# EasyEDA Pro project ProProject_Avaota Pi A_2024-03-25.epro, board PCB7
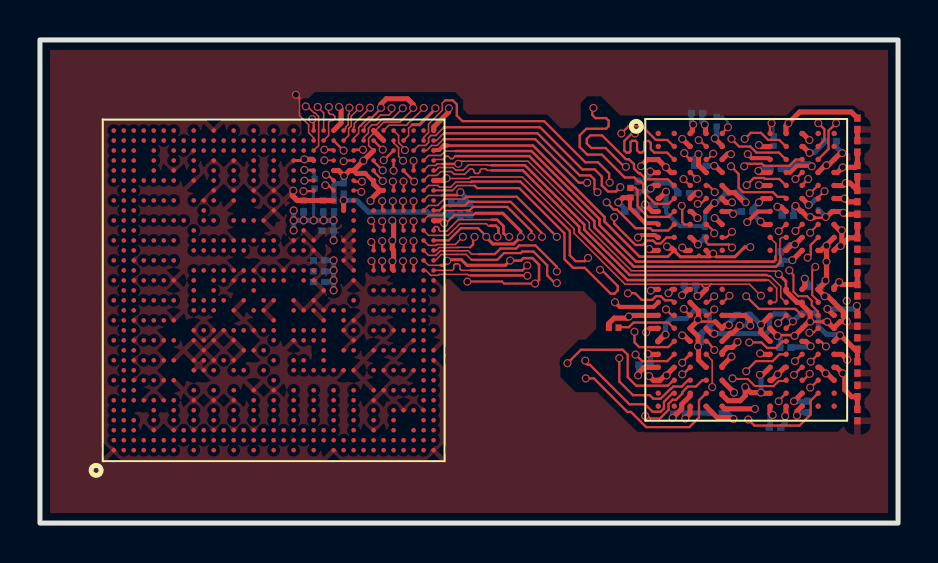
[diagram p17: board, top side]
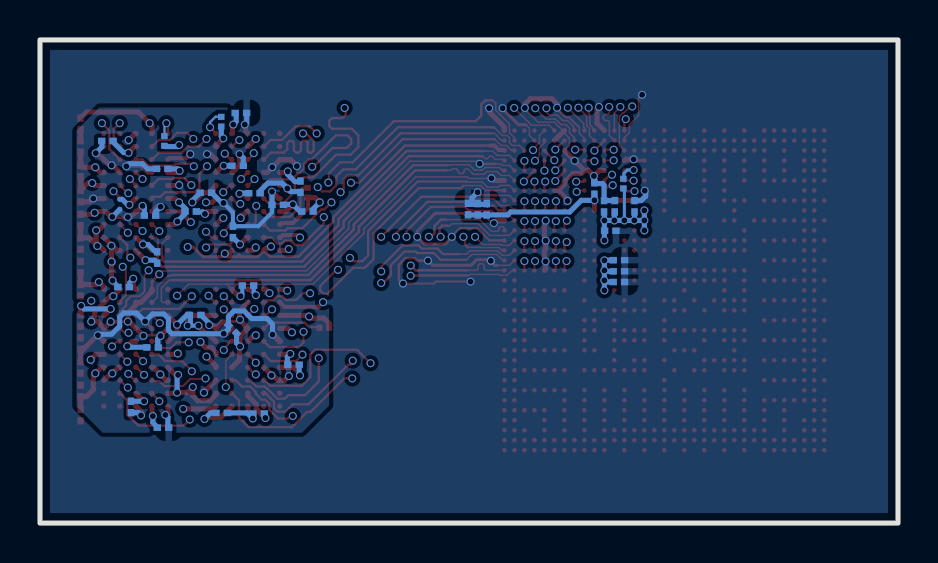
[diagram p18: board, bottom side, seen from below]

Outline 42.93 x 24.18 mm; copper layers: Top Layer, Inner1, Inner2, Inner3, Inner4, Inner5, Inner6, Bottom Layer. Coordinates in mm from the lower left corner of the outline.
Outline path: rectangle 0,24.18 42.93,0
Stack: Top Layer 0.035mm 外层铜厚1oz / Dielectric1 0.1164mm 2116 RC54% 4.9mil / Inner1 0.0152mm 内层铜厚 / Dielectric2 0.3mm 0.3mm H/HOZ 不含铜 / Inner2 0.0152mm 内层铜厚 / Dielectric3 0.0764mm 1080 RC67% 3.3mil / Inner3 0.0152mm 内层铜厚 / Dielectric4 0.0764mm 1080 RC67% 3.3mil / Inner4 0.0152mm 内层铜厚 / Dielectric5 0.3mm 0.3mm H/HOZ 不含铜 / Inner5 0.0152mm 内层铜厚 / Dielectric6 0.0764mm 1080 RC67% 3.3mil / Inner6 0.0152mm 内层铜厚 / Dielectric7 0.0764mm 1080 RC67% 3.3mil / Bottom Layer 0.035mm 外层铜厚1oz

## Design rules (mm)
net SDQM2: SDQ2
net SDQ22: SDQ2
net SDQ24: SDQ3
net SDQ21: SDQ2
net SDQ20: SDQ2
net SDQ31: SDQ3
net SDQ23: SDQ2
net SDQ19: SDQ2
net SDQ30: SDQ3
net SDQS2P: SDQ2
net SDQS2N: SDQ2
net SDQ26: SDQ3
net SDQ27: SDQ3
net SDQS3P: SDQ3
net SDQS3N: SDQ3
net SDQ17: SDQ2
net SDQM3: SDQ3
net SDQ18: SDQ2
net SDQ16: SDQ2
net SDQ28: SDQ3
net SDQ25: SDQ3
net SDQ29: SDQ3
net SAB2: SAA
net SAB3: SAA
net SAA5: SAA
net SAB0: SAA
net SCS0-B: SCK
net SCS1-B: SCK
net SCKE1-B: SCK
net SCKP-B: SCK
net SCKE0-B: SCK
net SAB1: SAA
net SAB5: SAA
net SCKN-B: SCK
net SAB4: SAA
net SCKE0-A: SCK
net SCS0-A: SCK
net SCKN-A: SCK
net SDQ14: SDQ1
net SAA4: SAA
net SDQ13: SDQ1
net SDQ12: SDQ1
net SDQ15: SDQ1
net SAA3: SAA
net SDQM1: SDQ1
net SDQS1P: SDQ1
net SDQS1N: SDQ1
net SDQ9: SDQ1
net SAA2: SAA
net SDQ10: SDQ1
net SDQ11: SDQ1
net SDQ8: SDQ1
net SCKP-A: SCK
net SCKE1-A: SCK
net SDQ1: SDQ0
net SDQ5: SDQ0
net SDQ7: SDQ0
net SDQ0: SDQ0
net SCS1-A: SCK
net SDQM0: SDQ0
net SDQS0P: SDQ0
net SDQS0N: SDQ0
net SDQ3: SDQ0
net SAA0: SAA
net SDQ4: SDQ0
net SDQ6: SDQ0
net SAA1: SAA
net SDQ2: SDQ0
template: 8L BGA
spacing safeClearance (default): track to track 0.076, other pairs 0.076 to 0.3
track width trackWidth (default): min 0.076, default 0.102, max 2.54
differential pair differentialPair (default): width min 0.102, default 0.254, max 2.54; gap min 0.102, default 0.102
via viaSize (default): diameter min 0.4, default 0.45, max 10; hole min 0.201, default 0.201, max 5.999
pour e746 uses DRAMCopper
pour e789 uses DRAMCopper
pour e875 uses DRAMCopper
pour e939 uses DRAMCopper
pour e1925 uses DRAMCopper

## Placement (name value [footprint] x y rotation side)
C1  2.2uF  [c0201 nsk]  33.83 5.51 180 bottom
C2  2.2uF  [c0201 nsk]  35.15 10.41 180 bottom
C3  100nF  [c0201 nsk]  36.78 4.78 0 bottom
C4  100nF  [c0201 nsk]  37.3 8.79 0 bottom
C5  100nF  [c0201 nsk]  39.55 19.13 180 bottom
C6  100nF  [c0201 nsk]  13.97 12.07 0 bottom
C7  100nF  [c0201 nsk]  13.97 12.6 0 bottom
C8  100nF  [c0201 nsk]  13.97 13.16 0 bottom
C9  100nF  [c0201 nsk]  14.71 15.85 270 bottom
C10  100nF  [c0201 nsk]  13.18 15.85 270 bottom
C11  100nF  [c0201 nsk]  14.17 15.85 270 bottom
C12  100nF  [c0201 nsk]  37.06 13.28 270 bottom
C13  100nF  [c0201 nsk]  36.8 17.73 180 bottom
C14  100nF  [c0201 nsk]  31.98 5.48 180 bottom
C15  100nF  [c0201 nsk]  32.51 11.89 180 bottom
C16  100nF  [c0201 nsk]  38.73 11.81 180 bottom
C17  2.2uF  [c0201 nsk]  15.19 16.75 90 bottom
C18  100nF  [c0201 nsk]  20.57 15.7 270 bottom
C19  2.2uF  [c0201 nsk]  40.89 8.99 90 top
C20  100nF  [c0201 nsk]  40.89 7.8 90 top
C21  100nF  [c0201 nsk]  37.41 15.39 180 bottom
C22  100nF  [c0201 nsk]  33.3 9.7 45 bottom
C23  100nF  [c0201 nsk]  31.04 15.93 0 bottom
C24  100nF  [c0201 nsk]  40.89 16.36 270 top
C25  100nF  [c0201 nsk]  33.27 14.58 90 bottom
C26  100nF  [c0201 nsk]  34.62 16.54 180 bottom
C27  2.2uF  [c0201 nsk]  30.25 7.92 0 bottom
C28  2.2uF  [c0201 nsk]  40.89 10.13 270 top
C29  100nF  [c0201 nsk]  35.39 15.6 0 bottom
C30  100nF  [c0201 nsk]  40.89 19.99 90 top
C31  100nF  [c0201 nsk]  40.89 18.85 270 top
C32  2.2uF  [c0201 nsk]  32.87 20.52 180 bottom
C33  100nF  [c0201 nsk]  40.89 17.63 90 top
C34  100nF  [c0201 nsk]  40.89 14 90 top
C35  100nF  [c0201 nsk]  40.89 11.66 90 top
C36  100nF  [c0201 nsk]  40.89 15.16 270 top
C37  100nF  [c0201 nsk]  40.89 12.8 270 top
C38  100nF  [c0201 nsk]  40.89 5.41 90 top
C39  100nF  [c0201 nsk]  40.89 6.6 270 top
C40  100nF  [c0201 nsk]  14.4 14.63 0 bottom
C41  100nF  [c0201 nsk]  33.05 17.88 0 bottom
C42  100nF  [c0201 nsk]  38.38 5.82 90 bottom
C43  100nF  [c0201 nsk]  32.21 16.51 0 bottom
C44  100nF  [c0201 nsk]  29.9 16.84 90 bottom
C45  100nF  [c0201 nsk]  29.54 15.6 180 bottom
C46  2.2uF  [c0201 nsk]  21.51 15.72 90 bottom
C47  100nF  [c0201 nsk]  21.03 15.7 270 bottom
R1  0  [r0201 nsk]  29.54 16.54 270 top
R2  0  [r0201 nsk]  28.7 9.78 180 top
R3  120  [r0201 nsk]  13.74 16.99 270 bottom
R4  240  [r0201 nsk]  33.86 20.09 270 bottom
R5  240  [r0201 nsk]  36.7 19.13 270 bottom
U1  T527  [T527-BGA664]  11.69 11.65 90 top
UD1  LPDDR4_FBGA200  [BGA200P65_80B1000_1500H90]  35.33 12.67 0 top

## Footprints (pads in the part's own frame, mm; a bottom-side part is the same pattern mirrored in y, then rotated)
BGA200P65_80B1000_1500H90
  round 0.27 smd: A1(-4.4,6.825) A2(-3.6,6.825) A3(-2.8,6.825) A4(-2,6.825) A5(-1.2,6.825) A8(1.2,6.825) A9(2,6.825) A10(2.8,6.825) A11(3.6,6.825) A12(4.4,6.825) AA1(-4.4,-6.175) AA2(-3.6,-6.175) AA3(-2.8,-6.175) AA4(-2,-6.175) AA5(-1.2,-6.175) AA8(1.2,-6.175) AA9(2,-6.175) AA10(2.8,-6.175) AA11(3.6,-6.175) AA12(4.4,-6.175) AB1(-4.4,-6.825) AB2(-3.6,-6.825) AB3(-2.8,-6.825) AB4(-2,-6.825) AB5(-1.2,-6.825) AB8(1.2,-6.825) AB9(2,-6.825) AB10(2.8,-6.825) AB11(3.6,-6.825) AB12(4.4,-6.825) B1(-4.4,6.175) B2(-3.6,6.175) B3(-2.8,6.175) B4(-2,6.175) B5(-1.2,6.175) B8(1.2,6.175) B9(2,6.175) B10(2.8,6.175) B11(3.6,6.175) B12(4.4,6.175) C1(-4.4,5.525) C2(-3.6,5.525) C3(-2.8,5.525) C4(-2,5.525) C5(-1.2,5.525) C8(1.2,5.525) C9(2,5.525) C10(2.8,5.525) C11(3.6,5.525) C12(4.4,5.525) D1(-4.4,4.875) D2(-3.6,4.875) D3(-2.8,4.875) D4(-2,4.875) D5(-1.2,4.875) D8(1.2,4.875) D9(2,4.875) D10(2.8,4.875) D11(3.6,4.875) D12(4.4,4.875) E1(-4.4,4.225) E2(-3.6,4.225) E3(-2.8,4.225) E4(-2,4.225) E5(-1.2,4.225) E8(1.2,4.225) E9(2,4.225) E10(2.8,4.225) E11(3.6,4.225) E12(4.4,4.225) F1(-4.4,3.575) F2(-3.6,3.575) F3(-2.8,3.575) F4(-2,3.575) F5(-1.2,3.575) F8(1.2,3.575) F9(2,3.575) F10(2.8,3.575) F11(3.6,3.575) F12(4.4,3.575) G1(-4.4,2.925) G2(-3.6,2.925) G3(-2.8,2.925) G4(-2,2.925) G5(-1.2,2.925) G8(1.2,2.925) G9(2,2.925) G10(2.8,2.925) G11(3.6,2.925) G12(4.4,2.925) H1(-4.4,2.275) H2(-3.6,2.275) H3(-2.8,2.275) H4(-2,2.275) H5(-1.2,2.275) H8(1.2,2.275) H9(2,2.275) H10(2.8,2.275) H11(3.6,2.275) H12(4.4,2.275) J1(-4.4,1.625) J2(-3.6,1.625) J3(-2.8,1.625) J4(-2,1.625) J5(-1.2,1.625) J8(1.2,1.625) J9(2,1.625) J10(2.8,1.625) J11(3.6,1.625) J12(4.4,1.625) K1(-4.4,0.975) K2(-3.6,0.975) K3(-2.8,0.975) K4(-2,0.975) K5(-1.2,0.975) K8(1.2,0.975) K9(2,0.975) K10(2.8,0.975) K11(3.6,0.975) K12(4.4,0.975) N1(-4.4,-0.975) N2(-3.6,-0.975) N3(-2.8,-0.975) N4(-2,-0.975) N5(-1.2,-0.975) N8(1.2,-0.975) N9(2,-0.975) N10(2.8,-0.975) N11(3.6,-0.975) N12(4.4,-0.975) P1(-4.4,-1.625) P2(-3.6,-1.625) P3(-2.8,-1.625) P4(-2,-1.625) P5(-1.2,-1.625) P8(1.2,-1.625) P9(2,-1.625) P10(2.8,-1.625) P11(3.6,-1.625) P12(4.4,-1.625) R1(-4.4,-2.275) R2(-3.6,-2.275) R3(-2.8,-2.275) R4(-2,-2.275) R5(-1.2,-2.275) R8(1.2,-2.275) R9(2,-2.275) R10(2.8,-2.275) R11(3.6,-2.275) R12(4.4,-2.275) T1(-4.4,-2.925) T2(-3.6,-2.925) T3(-2.8,-2.925) T4(-2,-2.925) T5(-1.2,-2.925) T8(1.2,-2.925) T9(2,-2.925) T10(2.8,-2.925) T11(3.6,-2.925) T12(4.4,-2.925) U1(-4.4,-3.575) U2(-3.6,-3.575) U3(-2.8,-3.575) U4(-2,-3.575) U5(-1.2,-3.575) U8(1.2,-3.575) U9(2,-3.575) U10(2.8,-3.575) U11(3.6,-3.575) U12(4.4,-3.575) V1(-4.4,-4.225) V2(-3.6,-4.225) V3(-2.8,-4.225) V4(-2,-4.225) V5(-1.2,-4.225) V8(1.2,-4.225) V9(2,-4.225) V10(2.8,-4.225) V11(3.6,-4.225) V12(4.4,-4.225) W1(-4.4,-4.875) W2(-3.6,-4.875) W3(-2.8,-4.875) W4(-2,-4.875) W5(-1.2,-4.875) W8(1.2,-4.875) W9(2,-4.875) W10(2.8,-4.875) W11(3.6,-4.875) W12(4.4,-4.875) Y1(-4.4,-5.525) Y2(-3.6,-5.525) Y3(-2.8,-5.525) Y4(-2,-5.525) Y5(-1.2,-5.525) Y8(1.2,-5.525) Y9(2,-5.525) Y10(2.8,-5.525) Y11(3.6,-5.525) Y12(4.4,-5.525)
c0201 nsk
  rect 0.368x0.324 smd: 1(-0.292,0) 2(0.28,0)
r0201 nsk
  rect 0.303x0.324 smd: 1(-0.241,0) 2(0.241,0)
T527-BGA664
  round 0.229 smd: A1(-8,8) A2(-7.5,8) A3(-7,8) A4(-6.5,8) A5(-6,8) A6(-5.5,8) A8(-4.5,8) A10(-3.5,8) A12(-2.5,8) A14(-1.5,8) A16(-0.5,8) A18(0.5,8) A20(1.5,8) A22(2.5,8) A24(3.5,8) A26(4.5,8) A28(5.5,8) A29(6,8) A30(6.5,8) A31(7,8) A32(7.5,8) A33(8,8) AA1(-8,-2) AA2(-7.5,-2) AA3(-7,-2) AA4(-6.5,-2) AA5(-6,-2) AA6(-5.5,-2) AA7(-5,-2) AA9(-4,-2) AA12(-2.5,-2) AA13(-2,-2) AA15(-1,-2) AA16(-0.5,-2) AA18(0.5,-2) AA19(1,-2) AA21(2,-2) AA22(2.5,-2) AA24(3.5,-2) AA26(4.5,-2) AA27(5,-2) AA28(5.5,-2) AA29(6,-2) AA30(6.5,-2) AA31(7,-2) AA32(7.5,-2) AA33(8,-2) AB2(-7.5,-2.501) AB3(-7,-2.5) AB9(-4,-2.501) AB10(-3.5,-2.5) AB11(-3,-2.5) AB12(-2.5,-2.5) AB13(-2,-2.5) AB14(-1.5,-2.5) AB15(-1,-2.5) AB17(0,-2.5) AB24(3.5,-2.5) AB32(7.5,-2.501) AB33(8,-2.5) AC1(-8,-3) AC2(-7.5,-3) AC3(-7,-3) AC4(-6.5,-3) AC5(-6,-3) AC6(-5.5,-3) AC7(-5,-3) AC9(-4,-3) AC15(-1,-3) AC17(0,-3) AC18(0.5,-3) AC19(1,-3) AC20(1.5,-3) AC22(2.5,-3) AC24(3.5,-3) AC26(4.5,-3) AC27(5,-3) AC28(5.5,-3) AC29(6,-3) AC30(6.5,-3) AC31(7,-3) AC32(7.5,-3) AC33(8,-3) AD1(-8,-3.5) AD2(-7.5,-3.5) AD9(-4,-3.5) AD11(-3,-3.5) AD13(-2,-3.5) AD14(-1.5,-3.5) AD15(-1,-3.5) AD20(1.5,-3.5) AD21(2,-3.5) AD22(2.5,-3.5) AD25(4,-3.5) AD32(7.5,-3.5) AD33(8,-3.5) AE1(-8,-4) AE2(-7.5,-4) AE3(-7,-4) AE4(-6.5,-4) AE5(-6,-4) AE6(-5.5,-4) AE7(-5,-4) AE9(-4,-4) AE11(-3,-4) AE12(-2.501,-4) AE13(-2,-4) AE14(-1.5,-4) AE16(-0.5,-4) AE18(0.5,-4) AE19(1,-4) AE20(1.5,-4) AE21(2,-4) AE22(2.501,-4) AE23(3,-4) AE24(3.5,-4) AE25(4,-4) AE26(4.5,-4) AE27(5,-4) AE28(5.5,-4) AE29(6,-4) AE30(6.5,-4) AE31(7,-4) AE32(7.5,-4) AE33(8,-4) AF1(-8,-4.5) AF2(-7.5,-4.5) AF32(7.5,-4.5) AF33(8,-4.5) AG1(-8,-5) AG2(-7.5,-5) AG3(-7,-5) AG4(-6.5,-5) AG5(-6,-5) AG6(-5.5,-5) AG7(-5,-5) AG9(-4,-5) AG11(-3,-5) AG13(-2,-5) AG15(-1,-5) AG17(0,-5) AG19(1,-5) AG21(2,-5) AG23(3,-5) AG25(4,-5) AG28(5.5,-5) AG29(6,-5) AG30(6.5,-5) AG31(7,-5) AG32(7.5,-5) AG33(8,-5) AH1(-8,-5.5) AH2(-7.5,-5.5) AH7(-5,-5.5) AH9(-4,-5.5) AH11(-3,-5.5) AH13(-2,-5.5) AH15(-1,-5.5) AH17(0,-5.5) AH19(1,-5.5) AH21(2,-5.5) AH23(3,-5.5) AH25(4,-5.5) AH27(5,-5.5) AH32(7.5,-5.5) AH33(8,-5.5) AJ1(-8,-6) AJ2(-7.5,-6) AJ3(-7,-6) AJ4(-6.5,-6) AJ5(-6,-6) AJ7(-5,-6) AJ9(-4,-6) AJ11(-3,-6) AJ13(-2,-6) AJ15(-1,-6) AJ17(0,-6) AJ19(1,-6) AJ21(2,-6) AJ23(3,-6) AJ25(4,-6) AJ27(5,-6) AJ30(6.5,-6) AJ31(7,-6) AJ32(7.5,-6) AJ33(8,-6) AK1(-8,-6.5) AK2(-7.5,-6.5) AK5(-6,-6.5) AK7(-5,-6.5) AK9(-4,-6.5) AK11(-3,-6.5) AK13(-2,-6.5) AK15(-1,-6.5) AK17(0,-6.5) AK19(1,-6.5) AK21(2,-6.5) AK23(3,-6.5) AK25(4,-6.5) AK27(5,-6.5) AK29(6,-6.5) AK32(7.5,-6.5) AK33(8,-6.5) AL1(-8,-7) AL2(-7.5,-7) AL3(-7,-7) AL5(-6,-7) AL7(-5,-7) AL9(-4,-7) AL11(-3,-7) AL12(-2.5,-7) AL13(-2,-7) AL14(-1.5,-7) AL15(-1,-7) AL16(-0.5,-7) AL17(0,-7) AL19(1,-7) AL21(2,-7) AL23(3,-7) AL25(4,-7) AL27(5,-7) AL29(6,-7) AL31(7,-7) AL32(7.5,-7) AL33(8,-7) AM1(-8,-7.5) AM2(-7.5,-7.5) AM3(-7,-7.5) AM4(-6.5,-7.5) AM5(-6,-7.5) AM6(-5.5,-7.5) AM7(-5,-7.5) AM8(-4.5,-7.5) AM9(-4,-7.5) AM10(-3.5,-7.5) AM11(-3,-7.5) AM12(-2.501,-7.5) AM13(-2,-7.5) AM14(-1.5,-7.5) AM15(-1,-7.5) AM16(-0.5,-7.5) AM17(0,-7.5) AM18(0.5,-7.5) AM19(1,-7.5) AM20(1.5,-7.5) AM21(2,-7.5) AM22(2.501,-7.5) AM23(3,-7.5) AM24(3.5,-7.5) AM25(4,-7.5) AM26(4.5,-7.5) AM27(5,-7.5) AM28(5.5,-7.5) AM29(6,-7.5) AM30(6.5,-7.5) AM31(7,-7.5) AM32(7.5,-7.5) AM33(8,-7.5) AN1(-8,-8) AN2(-7.5,-8) AN3(-7,-8) AN4(-6.5,-8) AN5(-6,-8) AN6(-5.5,-8) AN7(-5,-8) AN8(-4.5,-8) AN9(-4,-8) AN10(-3.5,-8) AN11(-3,-8) AN13(-2,-8) AN15(-1,-8) AN17(0,-8) AN18(0.5,-8) AN19(1,-8) AN20(1.5,-8) AN21(2,-8) AN22(2.5,-8) AN23(3,-8) AN24(3.5,-8) AN25(4,-8) AN26(4.5,-8) AN27(5,-8) AN28(5.5,-8) AN29(6,-8) AN30(6.5,-8) AN31(7,-8) AN32(7.5,-8) AN33(8,-8) B1(-8,7.5) B2(-7.5,7.5) B3(-7,7.5) B4(-6.5,7.5) B5(-6,7.5) B6(-5.5,7.5) B7(-5,7.5) B8(-4.5,7.5) B9(-4,7.5) B10(-3.5,7.5) B11(-3,7.5) B12(-2.501,7.5) B13(-2,7.5) B14(-1.5,7.5) B15(-1,7.5) B16(-0.5,7.5) B17(0,7.5) B18(0.5,7.5) B19(1,7.5) B20(1.5,7.5) B21(2,7.5) B22(2.501,7.5) B23(3,7.5) B24(3.5,7.5) B25(4,7.5) B26(4.5,7.5) B27(5,7.5) B28(5.5,7.5) B29(6,7.5) B30(6.5,7.5) B31(7,7.5) B32(7.5,7.5) B33(8,7.5) C1(-8,7) C2(-7.5,7) C3(-7,7) C4(-6.5,7) C6(-5.5,7) C7(-5,7) C8(-4.5,7) C9(-4,7) C10(-3.5,7) C11(-3,7) C12(-2.5,7) C13(-2,7) C14(-1.5,7) C15(-1,7) C16(-0.5,7) C17(0,7) C18(0.5,7) C19(1,7) C20(1.5,7) C21(2,7) C22(2.5,7) C23(3,7) C24(3.5,7) C25(4,7) C26(4.5,7) C27(5,7) C28(5.5,7) C29(6,7) C30(6.5,7) C31(7,7) C32(7.5,7) C33(8,7) D1(-8,6.5) D2(-7.5,6.5) D6(-5.5,6.5) D8(-4.5,6.5) D10(-3.5,6.5) D12(-2.5,6.5) D14(-1.5,6.5) D16(-0.5,6.5) D18(0.5,6.5) D20(1.5,6.5) D22(2.5,6.5) D24(3.5,6.5) D26(4.5,6.5) D28(5.5,6.5) D32(7.5,6.5) D33(8,6.5) E1(-8,6) E2(-7.5,6) E3(-7,6) E4(-6.5,6) E5(-6,6) E6(-5.5,6) E8(-4.5,6) E10(-3.5,6) E12(-2.5,6) E14(-1.5,6) E16(-0.5,6) E18(0.5,6) E20(1.5,6) E22(2.5,6) E24(3.5,6) E26(4.5,6) E28(5.5,6) E29(6,6) E30(6.5,6) E31(7,6) E32(7.5,6) E33(8,6) F1(-8,5.5) F2(-7.5,5.5) F6(-5.5,5.5) F8(-4.5,5.5) F10(-3.5,5.5) F12(-2.5,5.5) F14(-1.5,5.5) F16(-0.5,5.5) F18(0.5,5.5) F20(1.5,5.5) F22(2.5,5.5) F24(3.5,5.5) F26(4.5,5.5) F28(5.5,5.5) F32(7.5,5.5) F33(8,5.5) G1(-8,5) G2(-7.5,5) G3(-7,5) G4(-6.5,5) G5(-6,5) G6(-5.5,5) G8(-4.5,5) G10(-3.5,5) G12(-2.5,5) G14(-1.5,5) G16(-0.5,5) G18(0.5,5) G20(1.5,5) G22(2.5,5) G24(3.5,5) G26(4.5,5) G28(5.5,5) G29(6,5) G30(6.5,5) G31(7,5) G32(7.5,5) G33(8,5) H2(-7.5,4.5) H3(-7,4.5) H24(3.5,4.5) H31(7,4.5) H32(7.5,4.5) J1(-8,4) J2(-7.5,4) J3(-7,4) J4(-6.5,4) J5(-6,4) J6(-5.5,4) J7(-5,4) J9(-4,4) J10(-3.5,4) J12(-2.501,4) J13(-2,4) J15(-1,4) J16(-0.5,4) J17(0,4) J18(0.5,4) J19(1,4) J21(2,4) J22(2.501,4) J23(3,4) J26(4.5,4) J28(5.5,4) J29(6,4) J30(6.5,4) J31(7,4) J32(7.5,4) J33(8,4) K2(-7.5,3.5) K3(-7,3.5) K9(-4,3.5) K10(-3.5,3.5) K11(-3,3.5) K12(-2.5,3.5) K13(-2,3.5) K15(-1,3.5) K16(-0.5,3.5) K19(1,3.5) K21(2,3.5) K22(2.5,3.5) K24(3.5,3.5) K25(4,3.5) K26(4.5,3.5) K31(7,3.5) K32(7.5,3.5) L1(-8,3) L2(-7.5,3) L3(-7,3) L4(-6.5,3) L5(-6,3) L6(-5.5,3) L7(-5,3) L9(-4,3) L10(-3.5,3) L12(-2.5,3) L13(-2,3) L15(-1,3) L16(-0.5,3) L17(0,3) L18(0.5,3) L19(1,3) L21(2,3) L22(2.5,3) L24(3.5,3) L26(4.5,3) L27(5,3) L28(5.5,3) L29(6,3) L30(6.5,3) L31(7,3) L32(7.5,3) L33(8,3) M2(-7.5,2.501) M3(-7,2.5) M10(-3.5,2.5) M13(-2,2.5) M16(-0.5,2.5) M18(0.5,2.5) M19(1,2.5) M21(2,2.5) M22(2.5,2.5) M31(7,2.5) M32(7.5,2.501) N1(-8,2) N2(-7.5,2) N3(-7,2) N4(-6.5,2) N5(-6,2) N6(-5.5,2) N7(-5,2) N9(-4,2) N10(-3.5,2) N12(-2.5,2) N13(-2,2) N15(-1,2) N18(0.5,2) N19(1,2) N21(2,2) N22(2.5,2) N24(3.5,2) N26(4.5,2) N27(5,2) N28(5.5,2) N29(6,2) N30(6.5,2) N31(7,2) N32(7.5,2) N33(8,2) P2(-7.5,1.5) P3(-7,1.5) P9(-4,1.5) P11(-3,1.5) P13(-2,1.5) P16(-0.5,1.5) P18(0.5,1.5) P19(1,1.5) P21(2,1.5) P22(2.5,1.5) P24(3.5,1.5) P31(7,1.5) P32(7.5,1.5) R1(-8,1) R2(-7.5,1) R3(-7,1) R4(-6.5,1) R5(-6,1) R6(-5.5,1) R7(-5,1) R11(-3,1) R13(-2,1) R15(-1,1) R17(0,1) R18(0.5,1) R19(1,1) R22(2.5,1) R24(3.5,1) R26(4.5,1) R27(5,1) R28(5.5,1) R29(6,1) R30(6.5,1) R31(7,1) R32(7.5,1) R33(8,1) T2(-7.5,0.5) T3(-7,0.5) T9(-4,0.5) T11(-3,0.5) T13(-2,0.5) T15(-1,0.5) T16(-0.5,0.5) T18(0.5,0.5) T19(1,0.5) T21(2,0.5) T22(2.5,0.5) T24(3.5,0.5) T31(7,0.5) T32(7.5,0.5) U1(-8,0) U2(-7.5,0) U3(-7,0) U4(-6.5,0) U5(-6,0) U6(-5.5,0) U7(-5,0) U8(-4.5,0) U10(-3.5,0) U12(-2.5,0) U13(-2,0) U14(-1.5,0) U16(-0.5,0) U18(0.5,0) U19(1,0) U21(2,0) U22(2.5,0) U25(4,0) U26(4.5,0) U27(5,0) U28(5.5,0) U29(6,0) U30(6.5,0) U31(7,0) U32(7.5,0) U33(8,0) V2(-7.5,-0.5) V3(-7,-0.5) V18(0.5,-0.5) V19(1,-0.5) V31(7,-0.5) V32(7.5,-0.5) W1(-8,-1) W2(-7.5,-1) W3(-7,-1) W4(-6.5,-1) W5(-6,-1) W6(-5.5,-1) W7(-5,-1) W9(-4,-1) W10(-3.5,-1) W12(-2.5,-1) W13(-2,-1) W15(-1,-1) W16(-0.5,-1) W19(1,-1) W21(2,-1) W22(2.5,-1) W23(3,-1) W24(3.5,-1) W25(4,-1) W27(5,-1) W28(5.5,-1) W29(6,-1) W30(6.5,-1) W31(7,-1) W32(7.5,-1) W33(8,-1) Y2(-7.5,-1.5) Y3(-7,-1.5) Y9(-4,-1.5) Y10(-3.5,-1.5) Y12(-2.5,-1.5) Y13(-2,-1.5) Y15(-1,-1.5) Y18(0.5,-1.5) Y19(1,-1.5) Y21(2,-1.5) Y22(2.5,-1.5) Y23(3,-1.5) Y24(3.5,-1.5) Y26(4.5,-1.5) Y31(7,-1.5) Y32(7.5,-1.5)

## Nets
As in the schematic.

Pads without a net: U1 A2 A3 A4 A5 A6 A8 A10 A12 A14 A16 A18 A20 A22 A24 A26 A28 A29 A30 A31 A32 A33 AA1 AA2 AA3 AA4 AA5 AA6 AA7 AA9 AA12 AA13 AA19 AB2 AB3 AB9 AB13 AC2 AC3 AC4 AC5 AC6 AC7 AC9 AC15 AD1 AD2 AD15 AE1 AE2 AE3 AE4 AE5 AE6 AE7 AE11 AE13 AE16 AF1 AF2 AG1 AG2 AG4 AG5 AG9 AG13 AG15 AG17 AH1 AH2 AH11 AH13 AH15 AH17 AJ1 AJ2 AJ3 AJ4 AJ5 AJ7 AJ9 AJ11 AJ15 AJ17 AK1 AK2 AK7 AK9 AK13 AK15 AK17 AK33 AL1 AL2 AL5 AL7 AL11 AL15 AL16 AL17 AL27 AL32 AL33 AM1 AM2 AM3 AM4 AM6 AM7 AM8 AM9 AM10 AM11 AM12 AM13 AM14 AM15 AM16 AM17 AM18 AM33 AN2 AN3 AN4 AN5 AN6 AN7 AN8 AN9 AN13 AN15 AN17 AN26 B1 B2 B3 B4 B5 B6 B7 B8 B9 B10 B11 B12 B13 B14 B15 B16 B17 B18 B19 B20 B21 B22 B23 B24 B25 B26 B27 B28 B29 B30 B31 B32 B33 C1 C2 C3 C4 C7 C9 C11 C13 C15 C16 C17 C19 C21 C22 C23 C24 C25 C26 C27 C28 C29 C30 C31 C32 C33 D1 D2 D8 D10 D12 D14 D16 D18 D20 D22 D24 D26 D28 D32 D33 E1 E2 E4 E5 E6 E8 E10 E12 E14 E16 E18 E20 E22 E24 E26 E28 E29 E30 E31 E32 E33 F1 F2 F14 F16 F18 F20 F22 F24 F26 F28 F32 F33 G1 G2 G4 G5 G6 G12 G16 G20 G22 G24 G26 G28 G30 G31 G32 G33 H2 H3 H24 H31 H32 J1 J2 J4 J5 J7 J15 J16 J17 J18 J19 J21 J22 J23 J26 J29 J30 J32 J33 K2 K3 K13 K15 K16 K19 K21 K22 K24 K25 K31 K32 L1 L2 L4 L5 L7 L9 L15 L16 L17 L18 L19 L21 L22 L24 L26 L28 L29 L31 L32 M2 M3 M10 M16 M18 M19 M21 M22 M31 M32 N1 N2 N4 N5 N7 N9 N13 N21 N24 N28 N29 N31 N32 N33 P2 P3 P9 P13 P18 P21 P22 P31 P32 R1 R2 R4 R5 R6 R15 R17 R18 R22 R26 R28 R29 R30 R31 R32 R33 T2 T3 T9 T11 T13 T19 T21 T22 T31 T32 U1 U2 U3 U4 U5 U6 U8 U10 U12 U13 U18 U19 U21 U22 U26 U28 U29 U30 U31 U32 U33 V2 V3 V31 V32 W1 W2 W3 W4 W5 W6 W7 W9 W10 W19 W21 W28 W29 W31 W32 W33 Y2 Y3 Y9 Y10 Y12 Y13 Y19 Y21 Y31 Y32; UD1 A1 A2 A11 A12 AA1 AA12 AB1 AB2 AB11 AB12 B1 B12 G11 K5 K8 N5 N8

## Via types
v1: diameter 0.4, hole 0.3, Top Layer to Bottom Layer, 282 vias

## Routing (per net, layer and track width the routed paths; a pad name or vN(x,y) marks a point on that pad's centre or on a via; arc(x,y) is an arc through that point)
GND: length 193.2
  Top Layer w0.076: 16.03,19.89 15.94,19.8 15.94,19.51 15.69,19.26 U1.AE32 ; 18.62,19.94 18.44,19.76 18.44,19.4 U1.AK32 ; 33.06,11.96 33.58,11.96 ; 33.06,11.96 29.27,11.96 28,13.22 28,13.22 26.72,14.5 26.72,14.73 24.13,17.32 21.54,17.32 21.46,17.25 20.4,17.25 20.38,17.26 v1(20.34,17.26) ; 33.06,11.96 33.32,11.69 33.58,11.96 ; 33.58,11.96 35.49,11.96 v1(36.07,11.38) ; U1.AM20 19.44,12.9 20.05,12.9 ; 16.69,19.51 16.44,19.26 16.44,18.9 U1.AG31 ; 12.98,21.27 12.98,20.4 13.44,19.93 13.44,19.54 13.69,19.29 U1.AA32 ; U1.AG33 16.77,19.65 16.94,19.81 16.94,19.81 17.2,20.07 18.01,20.07 18.67,20.73 v1(18.67,20.78) ; U1.AM29 19.44,17.9 19.79,17.9 19.79,17.9 19.87,17.98 20.15,17.98 ; U1.AM26 19.44,16.4 20.11,16.4 ; v1(20.93,17.98) 21.06,18.11 24.41,18.11 27.48,15.04 27.48,14.73 29.59,12.63 36.48,12.63 36.49,12.62 36.8,12.62 v1(36.96,12.46) ; v1(12.8,21.43) 12.79,21.43 12.78,21.42 12.88,21.32
  Top Layer w0.102: v1(17.06,20.79) 17.06,20.74 16.62,20.31 16.46,20.31 16.04,19.89 16.03,19.89 ; v1(21.39,12.08) 21.39,12.09 23.11,12.09 23.22,11.99 v1(24.77,11.99) ; 16.69,19.51 U1.AG33 ; 21.8,15.5 21.76,15.5 21.67,15.42 20.72,15.42 20.32,15.01 v1(20.22,15.01)
  Top Layer w0.115: U1.AN22 20.45,14.15 21.06,14.76 21.92,14.76 22.33,14.35 v1(22.33,14.33)
  Top Layer w0.127: v1(12.8,21.43) 12.8,21.38 12.87,21.38 12.98,21.27 ; 20.11,16.4 20.13,16.42 20.89,16.42 v1(21.03,16.56) ; 38.71,15.28 39.31,15.28 ; 33.78,10.08 33.02,10.08 v1(32.92,10.18) ; 20.15,17.98 20.86,17.98 20.86,17.98 v1(20.93,17.98) ; v1(23.52,13.14) 24.06,13.14 24.18,13.26 24.64,13.26 24.97,12.93 24.97,12.17 24.79,11.99 v1(24.77,11.99) ; 20.39,18.9 24.66,18.9 28.24,15.32 28.24,15.09 30,13.34 31.41,13.34 31.72,13.64 ; v1(38.53,10.08) 38.54,10.08 39.2,10.08 ; v1(36.9,9.36) 36.94,9.41 37.71,9.41 v1(37.75,9.37) ; 37.32,11.69 37.32,12.09
  Top Layer w0.152: 18.62,19.94 18.99,19.94 19.77,20.73 19.77,20.76 v1(19.78,20.76) ; v1(35.53,13.82) 35.26,13.82 34.76,13.33 33.84,13.33 v1(33.68,13.49) 33.52,13.33 33.05,13.33 32.97,13.41 32.88,13.33 32.04,13.33 31.72,13.64 ; U1.W30 13.17,18.15 v1(13.23,18.2) ; v1(23.52,13.14) 23.29,12.9 21.36,12.9 21.08,13.18 20.43,13.18 v1(20.37,13.13) 20.37,13.1 20.17,12.9 20.05,12.9 ; v1(22.33,14.33) 22.33,14.3 22.66,13.97 23.7,13.97 v1(24.05,14.33) 24.05,14.61 23.15,15.5 21.8,15.5 ; v1(36.96,12.46) 37.32,12.09
  Top Layer w0.203: 37.32,17.54 37.53,17.54 37.87,17.88 38.58,17.88 v1(38.61,17.86) ; 30.92,11.04 30.7,10.82 29,10.82 v1(28.76,11.06) ; 16.28,17.5 16.63,17.15 U1.AG28 ; v1(35.38,15.06) 35.91,15.59 36.52,15.59 ; 36.52,18.19 36.45,18.26 35.61,18.26 v1(35.41,18.47) ; 30.92,14.29 30.89,14.29 30.77,14.41 30.09,14.41 29.97,14.3 29.93,14.3 v1(29.92,14.29) ; U1.AN31 19.72,18.67 19.97,18.67 20.19,18.9 20.39,18.9
  Top Layer w0.254: 34.12,5.84 34.25,5.72 v1(35.76,5.72) ; 39.31,15.28 39.36,15.32 ; 39.36,15.32 39.63,15.59 40.13,15.59 v1(40.19,15.53) 40.27,15.46 C36.1 ; 39.36,15.32 v1(39.31,15.32) ; v1(40.39,8.17) 40.12,8.44 39.72,8.44 ; v1(20.22,15.01) 20.1,15.13 19.71,15.13 U1.AN24 ; v1(35.97,16.92) 35.99,16.89 36.52,16.89 ; 34.12,18.19 34.39,18.47 v1(34.57,18.47) ; v1(39.39,10.08) 39.39,10.07 39.72,9.74 39.72,9.77 40.03,10.08 v1(40.36,10.08) 40.36,10.16 40.19,10.33 40.19,10.57 39.41,11.35 v1(39.26,11.35) 38.92,11.69 39.3,12.07 v1(39.3,12.14) 39.35,12.19 v1(39.35,13.08) 39.35,13.87 v1(39.35,13.88) ; v1(31.45,11.51) 31.63,11.69 31.72,11.69 ; v1(16.54,16.12) 16.54,16.18 17,16.65 ; U1.AC26 U1.AA26 U1.Y26 12.88,16.15 12.62,16.41 12.62,16.58 U1.W27 ; v1(16.18,18.14) 16.69,18.65 ; 34.12,7.14 34.72,6.54 v1(34.72,6.53) ; v1(20.45,20.76) 20.43,20.74 20.43,20.56 19.7,19.83 19.7,19.67 19.69,19.66 U1.AN33 ; 32.52,11.04 32.95,10.62 32.95,10.21 v1(32.92,10.18) 32.92,10.18 32.92,10.14 32.52,9.74 32.92,9.34 32.92,8.85 v1(32.92,8.84) 32.94,8.81 32.94,8.17 33.32,7.79 ; v1(36.65,5.41) 36.58,5.41 36.52,5.47 36.52,5.84 ; v1(32.94,18.47) 32.94,17.92 33.32,17.54 ; 30.92,8.44 30.55,8.44 30.53,8.46 30.42,8.46 30.42,8.47 v1(30.4,8.47) ; 32.52,5.84 32.52,5.47 v1(32.28,5.23) ; v1(32.9,11.36) 32.98,11.36 33.32,11.69 ; 39.2,10.08 39.39,10.08 ; 34.12,8.44 34.12,8.53 34.37,8.79 34.64,8.79 34.9,9.05 v1(34.9,9.07) ; v1(37.87,5.38) 37.87,5.59 38.12,5.84 ; v1(18.67,20.78) 18.67,20.96 18.39,21.23 17.32,21.23 17.06,20.97 v1(17.06,20.79) ; 16.28,17.5 15.84,17.5 15.69,17.65 16.18,18.14 ; v1(32.68,19.95) 32.64,19.9 32.64,19.61 32.52,19.49 ; 17,16.65 16.69,16.96 U1.AG28 ; 17,16.65 U1.AH27 ; v1(39.35,13.88) 39.35,13.92 39.72,14.29 ; v1(39.35,13.88) 39.34,13.88 39.34,13.87 39.3,13.87 39.07,13.64 38.92,13.64 ; v1(30.47,7.36) 30.69,7.14 31.02,7.14 31.27,7.39 v1(31.35,7.39) 31.35,7.42 31.72,7.79 ; 39.72,16.89 40.19,16.89 v1(40.31,17.02) 40.53,17.02 C24.1 C33.1 ; 38.12,14.29 v1(37.77,13.94) 37.75,13.92 37.6,13.92 37.32,13.64 ; v1(34.46,9.91) 34.28,9.91 34.12,9.74 33.78,10.08 ; v1(14.96,20.83) 15.06,20.73 15.06,20.02 U1.AC33 ; v1(33.68,13.49) 33.47,13.49 33.32,13.64 ; 34.12,16.89 34.48,16.54 34.75,16.54 35.23,16.05 v1(35.31,16.05) ; 31.72,17.54 31.57,17.54 31.32,17.8 31.32,17.81 v1(31.31,17.81) 31.3,17.81 30.92,18.19 30.39,18.19 30.07,17.88 v1(30.07,17.86) ; 32.52,15.59 32.59,15.59 32.89,15.29 v1(32.89,15.27) ; 38.92,7.79 39.01,7.79 v1(39.31,7.49) 39.37,7.49 39.72,7.14 ; C30.1 C31.1 ; U1.AE29 15.49,17.65 v1(15.21,17.37) 14.94,17.65 U1.AC29 ; v1(38.49,19.17) 38.17,19.49 38.12,19.49 ; v1(37.8,15.88) 38.08,15.59 38.12,15.59 38.4,15.31 v1(38.53,15.31) 38.57,15.28 38.71,15.28 ; 31.72,13.64 31.6,13.76 31.45,13.76 v1(31.37,13.84) ; U1.AG33 U1.AH32 ; v1(30.55,16.75) 30.7,16.89 30.92,16.89 ; U1.AJ19 17.63,12.71 v1(17.63,13.1) 17.69,13.16 U1.AJ21 17.63,13.71 v1(17.63,14.14) 17.69,14.2 U1.AJ23 17.69,15.07 v1(17.63,15.14) ; 36.52,9.74 v1(36.9,9.36) ; 30.92,15.59 30.64,15.59 v1(30.28,15.95) ; v1(40.14,18.52) 40.04,18.52 39.48,17.95 39.39,17.95 v1(39.34,17.91) 39.28,17.91 38.92,17.54 ; v1(20.34,17.26) 20.31,17.26 20.24,17.19 20.23,17.19 20.19,17.15 U1.AN28 ; U1.AA30 13.64,18.2 v1(13.23,18.2) ; 36.52,8.44 36.16,8.44 36.12,8.48 36.07,8.48 36.06,8.49 v1(36.03,8.49) ; v1(30.33,9.55) 30.52,9.74 30.92,9.74 ; 34.12,15.59 34.55,15.59 v1(34.67,15.47) ; 37.32,11.69 37.32,11.6 37.88,11.04 38.12,11.04 38.12,10.93 38.53,10.52 v1(38.53,10.08) 38.52,10.08 38.45,10.08 v1(37.75,9.37) 37.7,9.32 ; 36.52,7.14 36.61,7.14 v1(36.91,7.44) 37.26,7.79 37.32,7.79 ; 32.52,14.29 32.57,14.29 v1(32.92,13.94)